# EasyEDA Pro project 立创天空星STM32F407主板.eprj, board PCB1 (continued)
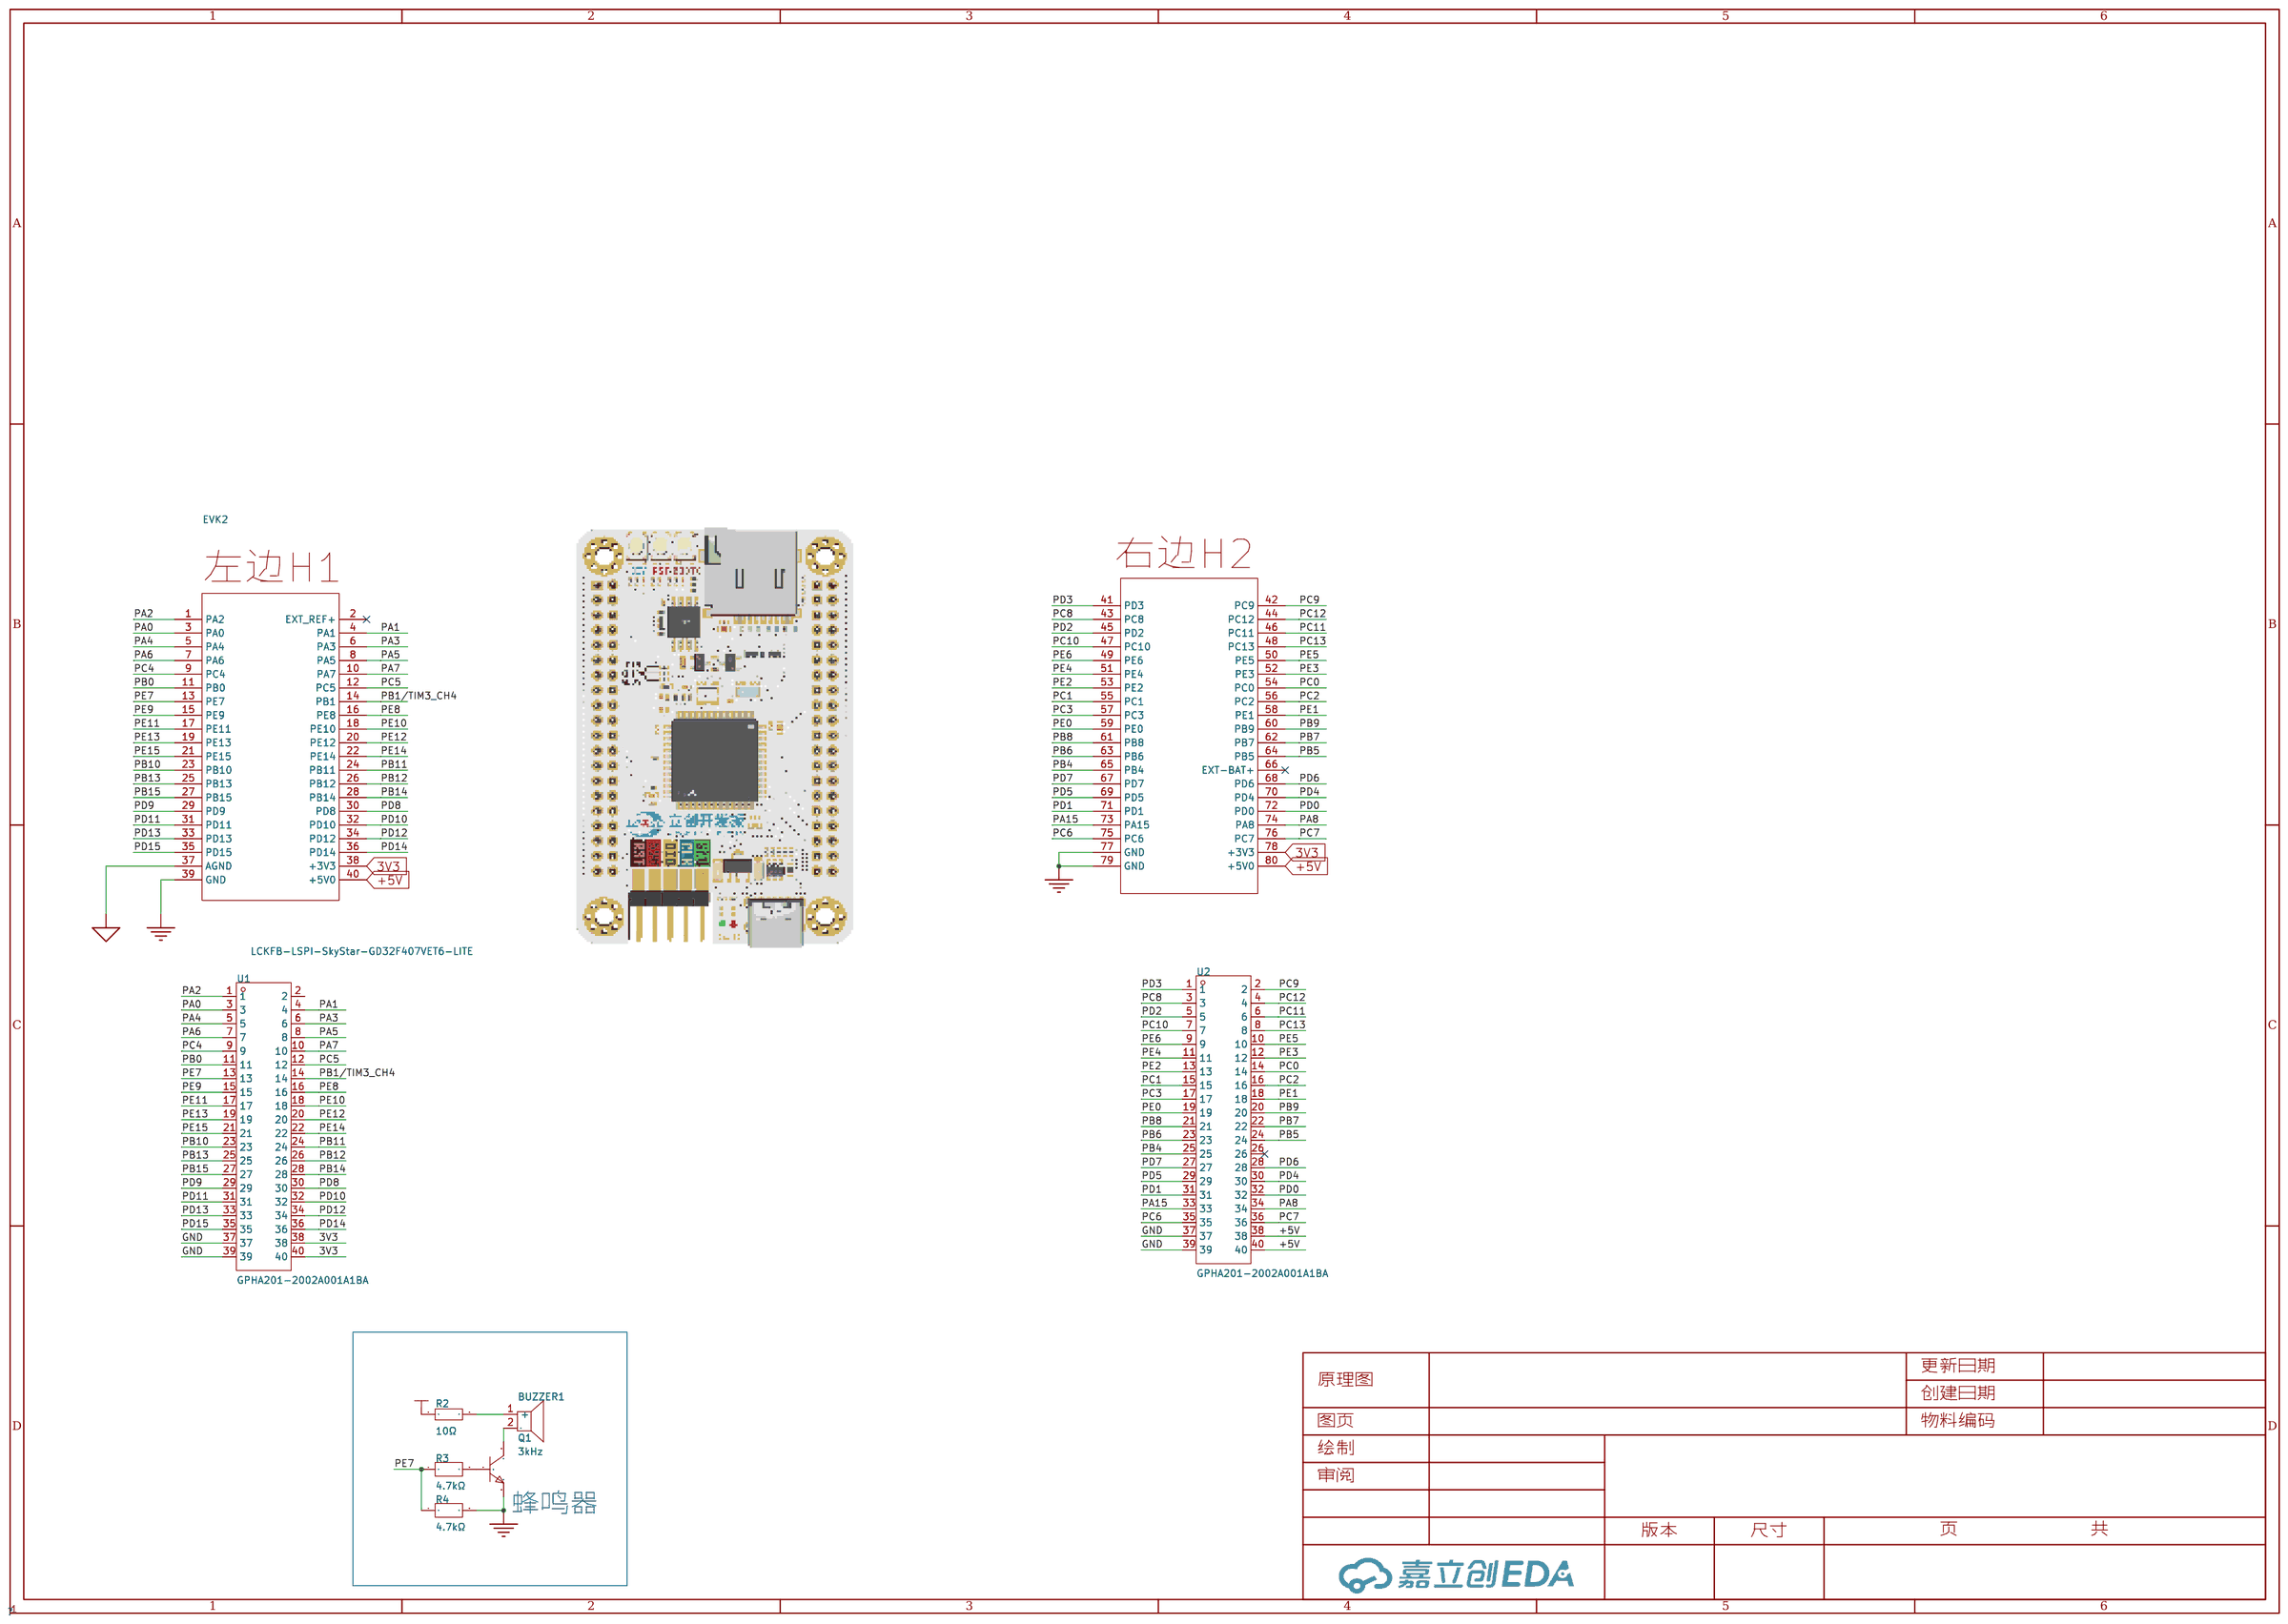
[diagram p0: 核心+音频输出]
## Footprints (pads in the part's own frame, mm; a bottom-side part is the same pattern mirrored in y, then rotated) (continued)
HDR-TH_40P-P2.54-V-M-R2-C20-S2.54
  rect 1.575x1.8 hole 1.1: 1(-24.13,-1.27)
  round 1.8 hole 1.1: 2(-24.13,1.27) 3(-21.59,-1.27) 4(-21.59,1.27) 5(-19.05,-1.27) 6(-19.05,1.27) 7(-16.51,-1.27) 8(-16.51,1.27) 9(-13.97,-1.27) 10(-13.97,1.27) 11(-11.43,-1.27) 12(-11.43,1.27) 13(-8.89,-1.27) 14(-8.89,1.27) 15(-6.35,-1.27) 16(-6.35,1.27) 17(-3.81,-1.27) 18(-3.81,1.27) 19(-1.27,-1.27) 20(-1.27,1.27) 21(1.27,-1.27) 22(1.27,1.27) 23(3.81,-1.27) 24(3.81,1.27) 25(6.35,-1.27) 26(6.35,1.27) 27(8.89,-1.27) 28(8.89,1.27) 29(11.43,-1.27) 30(11.43,1.27) 31(13.97,-1.27) 32(13.97,1.27) 33(16.51,-1.27) 34(16.51,1.27) 35(19.05,-1.27) 36(19.05,1.27) 37(21.59,-1.27) 38(21.59,1.27) 39(24.13,-1.27) 40(24.13,1.27)
IND-SMD_L5.2-W5.2_MCW-0530
  rect 1.9x2.5 smd: 1(-2.1,0) 2(2.1,0)
IND-SMD_L5.4-W5.2_FXL0530
  rect 1.9x2.5 smd: 1(-2.05,0) 2(2.05,0)
IND-SMD_L7.2-W6.6_GPSR07X0
  rect 2.35x3.5 smd: 1(-2.85,0) 2(2.85,0)
LED0603-RD
  rect 0.8x0.8 smd: 1(-0.799,0) 2(0.799,0)
LED0603-RD-YELLOW
  rect 0.8x0.8 smd: 1(-0.799,-0.004) 2(0.799,0.004)
LED0805-R-RD
  rect 1x1.399 smd: 1(1.05,0) 2(-1.05,0)
Pad_e2592
  round 10 hole 10: 1(0,0)
Pad_e2593
  oval 3.2x4.5 hole 3.2x4.5: 1(0,0)
Pad_e2594
  oval 3.2x5.2 hole 3.2x5.2: 1(0,0)
Pad_e2595
  oval 3.2x5.2 hole 3.2x5.2: 1(0,0)
Pad_e2596
  oval 3.2x5.2 hole 3.2x5.2: 1(0,0)
R0402
  rect 0.566x0.54 smd: 1(-0.433,0) 2(0.433,0)
R0603
  rect 0.806x0.864 smd: 1(-0.753,0) 2(0.753,0)
R0805
  rect 1.133x1.377 smd: 1(-1,0) 2(1,0)
RES-ADJ-SMD_3P-L3.8-W3.7_VGF39NCHXT
  rect 1.2x1.2 smd: 1(1.675,-1) 3(1.675,1)
  rect 1.6x1.5 smd: 2(-1.675,0.009)
SMA_L4.3-W2.6-LS5.0-FD
  rect 2.046x1.62 smd: 1(-2.304,-0.009) 2(2.304,0.009)
SOD-123_L2.7-W1.6-LS3.7-RD
  rect 0.91x1.22 smd: 1(-1.635,0) 2(1.635,0)
SOIC-16_L9.9-W3.9-P1.27-LS6.0-BL
  oval 0.602x1.971 smd: 1(-4.445,-2.736) 2(-3.175,-2.736) 3(-1.905,-2.736) 4(-0.635,-2.736) 5(0.635,-2.736) 6(1.905,-2.736) 7(3.175,-2.736) 8(4.445,-2.736) 9(4.445,2.736) 10(3.175,2.736) 11(1.905,2.736) 12(0.635,2.736) 13(-0.635,2.736) 14(-1.905,2.736) 15(-3.175,2.736) 16(-4.445,2.736)
SOT-23-3_L2.9-W1.3-P1.90-LS2.4-BR
  rect 1.25x0.7 smd: 1(1,-0.95) 2(1,0.95) 3(-1,0)
SOT-23-3_L3.0-W1.7-P0.95-LS2.9-BR
  rect 1.038x0.532 smd: 1(1.101,-0.95) 2(1.101,0.95) 3(-1.101,0)
SOT-23-5_L3.0-W1.7-P0.95-LS2.8-BL
  rect 0.49x1.157 smd: 1(-0.95,-1.153) 2(0,-1.153) 3(0.95,-1.153)
  rect 0.49x1.175 smd: 4(0.95,1.153) 5(-0.95,1.153)
SW-SMD_L6.0-W3.3-LS8.0
  rect 1.9x1.5 smd: 1(-4,0) 2(4,0)
SW-TH_SHOU-HAN_SS12D10G4
  oval 1.7x2.9 hole 1.1x2.3: 1(-4.8,0) 2(0,0) 3(4.8,0)
TO-252-2_L6.6-W6.1-P4.57-LS9.9-TL-CW
  rect 2.8x1.3 smd: 1(-3.292,2.273) 3(-3.292,-2.273)
  rect 6.5x6 smd: 2(3.292,0)
WIRELM-SMD_WT8266-S5-ESP-12F
  rect 2.5x1 smd: 1(-7.6,7.7) 2(-7.6,5.7) 3(-7.6,3.7) 4(-7.6,1.7) 5(-7.6,-0.3) 6(-7.6,-2.3) 7(-7.6,-4.3) 8(-7.6,-6.3) 9(7.6,-6.3) 10(7.6,-4.3) 11(7.6,-2.3) 12(7.6,-0.3) 13(7.6,1.7) 14(7.6,3.7) 15(7.6,5.7) 16(7.6,7.7)
  rect 1x1.8 smd: 17(-5,-7.7) 18(-3,-7.7) 19(-1,-7.7) 20(1,-7.7) 21(3,-7.7) 22(5,-7.7)
WIREPAD-4X6
  rrect 6x4 smd: 1(0,0)

## Nets
As in the schematic.

Pads without a net: CN2 3 4; EVK2 2 66; H5 2; H9 5 6; H10 5 6; H13 6; NOREF 1; NOREF#2 1; NOREF#3 1; NOREF#4 1; NOREF#5 1; P2 7 8; U1 2; U2 26; U9 4; U10 7; U11 7 10; U12 5 6; U13 2 4 5 6 7 11 13 14 17 18 19 20 21 22; X1 19 20

## Via types
v1: diameter 0.61, hole 0.305, Top Layer to Bottom Layer, 62 vias

## Routing (per net, layer and track width the routed paths; a pad name or vN(x,y) marks a point on that pad's centre or on a via; arc(x,y) is an arc through that point)
3V3: length 441.4
  Top Layer w0.254: 39.33,74.13 39.33,77.56 39.09,77.8 Q3.1 37.54,77.8 37.15,77.41 R50.2 ; 39.33,74.13 39.33,70.17 ; 39.33,74.13 39.25,74.05 Q4.1 37.73,74.05 37.22,73.55 R52.2 ; 39.33,70.17 39.25,70.25 Q5.1 38.27,70.32 37.68,70.32 37.22,69.86 R54.2 ; 39.33,70.17 39.33,62.26 45.72,55.88 ; X1.18 45.75,90.51
  Top Layer w0.762: 62.1,29.81 59.14,29.81 42.13,46.82 R2.1 42.13,52.29 63.08,73.24 63.08,84.72 ; 62.1,29.81 62.06,29.77 62.06,20.79 63.06,19.79 C23.2 66.53,19.77 R44.1 65.24,16.98 64.47,16.21 64.47,4.28 H10.2 61.17,0.98 44.53,0.98 43.78,1.73 43.78,2.7 ; 62.1,29.81 71.08,29.81 72.1,28.79 P1.2 ; U13.8 90.22,23.03 C22.2 ; H11.9 9.36,90.51 v1(46.44,90.51) C18.2 ; C22.2 90.26,31.24 ; C22.2 91.34,23.06 92.02,22.38 R43.1 R42.1 ; 90.26,31.24 90.26,35.39 98.26,43.4 98.26,85.69 94.31,89.63 R34.2 79.99,89.63 ; 90.26,31.24 90.21,31.2 R31.2 ; P2.1 41.13,9.72 43.78,7.07 43.78,2.7 ; U1.38 U1.40 76.54,87.4 76.54,89.45 76.43,89.56 ; H12.1 82.13,97.62 79.99,95.49 79.99,89.63 ; U9.5 46.44,89.56 ; R20.2 76.54,89.56 ; 76.54,89.56 76.43,89.56 ; 76.54,89.56 76.61,89.63 79.99,89.63 ; 76.43,89.56 64.92,89.56 63.08,87.72 63.08,84.72 ; 63.08,84.72 67.32,84.72 EVK2.38 ; 43.78,2.7 43.75,2.73 H9.2
  Bottom Layer w0.762: v1(46.44,90.51) 74,90.51 81.12,97.62 H12.1 ; EVK2.78 30.09,86.45 v1(30.09,90.48)
+5V: length 243.2
  Top Layer w0.508: 38.83,89.56 U9.1 42.19,89.56 42.51,89.24 42.51,88.1 42.07,87.66 U9.3
  Top Layer w0.762: v1(37.43,89.61) 37.48,89.56 C17.2 ; EVK2.80 29.97,89.11 24.65,89.11 U2.40 U2.38 18.4,84.83 12.27,78.69 R6.2 12.27,74.52 17.67,69.13 17.67,66.99 ; L1.1 v1(94.18,25.36) ; 17.67,66.99 17.53,67.13 11.66,67.13 11.65,67.12 11.65,65.24 12.28,64.61 R5.2 ; 17.67,66.99 H17.1 H16.1 ; U9.3 41.35,84.55 42.63,83.27 R55.2
  Bottom Layer w0.762: v1(94.18,25.36) 94.18,61.64 95.47,62.93 H13.1 95.47,95.02 94.64,95.85 80.85,95.85 74.62,89.61 67.35,89.61 ; EVK2.80 34.16,89.61 v1(37.43,89.61) 67.35,89.61 ; 67.35,89.61 67.37,89.59 EVK2.40
GND:
  vias: v1(0.72,44.67) v1(0.85,45.43) v1(1.1,77.99) v1(1.1,76.8) v1(1.53,45.43) v1(13.8,3.9) v1(13.8,2.71) v1(13.8,1.55) v1(45.17,88.41) v1(45.17,87.59) v1(45.68,87.08) v1(46.44,36.03) v1(46.44,35.13) v1(47.33,35.78) v1(47.33,34.67) v1(50.88,87.11) v1(51.27,87.97) v1(51.52,30.95) v1(51.52,30.05) v1(51.65,87.08) v1(52.54,87.08) v1(55.72,78.83) v1(56.61,79.59) v1(56.95,78.7) v1(57.37,43.4)
VCCBAT:
  vias: v1(7.12,35.14) v1(8.09,35.14) v1(8.22,37.43) v1(8.72,36.67) v1(8.72,35.76)
VCCSERVO: length 25.8
  Top Layer w0.762: R8.2 5.88,77.44
  Bottom Layer w0.762: 5.02,77.44 3.4,77.44 1.61,75.65 R7.2 ; 5.02,77.44 4.91,77.54 H4.2 H3.2 4.91,88.33 H15.2 ; 5.02,77.44 v1(5.88,77.44) D2.2
AD1: length 59.8
  Top Layer w0.254: EVK2.57 34.2,59.32 32.99,60.53 31.21,60.53 30.11,59.42 U2.17
  Bottom Layer w0.254: H11.7 15.46,89.5 25.61,89.5 26.89,88.23 26.89,60.86 U2.17
AD2: length 63
  Top Layer w0.254: EVK2.56 30.61,55.58 24.22,55.58 U2.16
  Bottom Layer w0.254: H11.6 17.49,90 25.81,90 27.3,88.51 27.3,59.18 26.25,58.13 24.15,58.13 U2.16
AD3: length 59
  Top Layer w0.254: EVK2.55 33.15,57.99 31.09,57.99 29.98,56.89 U2.15
  Bottom Layer w0.254: H11.5 19.52,90.51 26,90.51 27.74,88.77 27.74,58.85 25.77,56.89 U2.15
AD4: length 62
  Top Layer w0.254: EVK2.54 30.61,53.04 24.22,53.04 U2.14
  Bottom Layer w0.254: U2.14 24.15,55.59 26.38,55.59 28.18,57.39 28.18,88.96 26,91.15 21.42,91.15 H11.4
AD5: length 99.7
  Top Layer w0.254: v1(64.73,50.51) 67.91,50.51 69.2,49.21 EVK2.9 74.51,49.21 75.79,50.5 77.81,50.5 U1.9
  Bottom Layer w0.254: H11.3 23.33,91.78 26,91.78 28.6,89.17 28.6,55.25 30.81,53.05 53.47,53.05 56.01,50.51 v1(64.73,50.51)
AD6: length 92.6
  Top Layer w0.254: EVK2.12 68.63,50.5 75.2,50.5 U1.12
  Bottom Layer w0.254: EVK2.12 55.73,51.75 53.92,53.56 37.73,53.56 35.7,55.59 30.46,55.59 29.02,57.02 29.02,89.38 25.98,92.42 25.23,92.42 H11.2
AD7: length 92.1
  Top Layer w0.254: EVK2.11 74.63,51.75 75.92,53.04 77.81,53.04 U1.11
  Bottom Layer w0.254: H11.1 24.6,94.59 29.43,89.76 29.43,59.19 30.62,58 35.37,58 39.31,54.06 54.42,54.06 55.44,53.05 68.62,53.05 EVK2.11 ; 24.51,95.6 24.51,95.59
CLK: length 23.4
  Top Layer w0.254: v1(41.75,72.23) 41.82,72.3 R51.1 41.81,73.1 Q4.3 ; v1(49.75,78.45) U11.2 52.29,78.45 52.92,77.81 57.24,77.81 57.87,78.45 U10.2
  Bottom Layer w0.254: v1(49.75,78.45) 47.97,78.45 v1(41.75,72.23)
CLK_IN: length 18.3
  Top Layer w0.254: U2.23 29.68,67.05 30.78,68.15 33.15,68.15 EVK2.63 35.9,68.49 35.9,70.32 36.79,71.21 R52.1 36.97,72.68 37.5,72.15 Q4.2
DATA: length 26.5
  Top Layer w0.254: Q5.3 R53.1 41.87,69.25 v1(41.87,68.54) ; v1(54.19,86.83) 54.19,86.14 U10.9
  Bottom Layer w0.254: v1(54.19,86.83) 54.19,80.86 v1(41.87,68.54)
DATA_IN: length 20.1
  Top Layer w0.254: Q5.2 38.27,68.42 37.38,68.42 R54.1 36.79,66.64 35.78,65.62 33.13,65.62 EVK2.64 30.61,65.74 24.22,65.74 U2.24
ECD1_DIR: length 66.5
  Top Layer w0.254: EVK2.51 34.32,51.7 32.99,53.04 31.34,53.04 30.11,51.81 U2.11
  Bottom Layer w0.254: H9.4 38.32,4.03 35.52,4.03 28.28,11.27 28.28,48.97 U2.11
ECD1_PULSE: length 55.9
  Top Layer w0.254: U2.9 30.11,49.27 31.21,50.37 33.15,50.37 EVK2.49
  Bottom Layer w0.254: H9.3 39.62,43.9 EVK2.49
ECD2_DIR: length 52.1
  Top Layer w0.254: EVK2.4 68.76,40.21 75.07,40.21 U1.4
  Bottom Layer w0.254: H10.4 61.68,4.03 61.68,35.9 EVK2.4
ECD2_PULSE: length 54.2
  Top Layer w0.254: U1.3 77.81,42.88 75.92,42.88 74.63,41.59 EVK2.3
  Bottom Layer w0.254: H10.3 60.38,36.63 66.64,42.89 68.62,42.89 EVK2.3
ECHO: length 47.1
  Top Layer w0.254: U1.23 77.81,68.28 75.92,68.28 74.63,66.99 EVK2.23 ; H13.3 H12.3
  Bottom Layer w0.254: U1.23 81.9,67.05 90.39,75.53 H13.3
ESP/RX: length 65.4
  Top Layer w0.254: EVK2.1 74.51,39.05 75.79,40.34 78.84,40.34 79.09,40.08 79.09,39.15 U1.1
  Top Layer w0.762: U13.15 69.92,11.03 68.03,9.14 68.03,4.91 65.75,2.63 H14.2
  Bottom Layer w0.254: U1.1 79.08,39.07 79.08,30.19 77.94,29.05 67.53,29.05 65.62,27.14 65.62,13.93 v1(69.18,10.38)
ESP/TX: length 66.7
  Top Layer w0.254: EVK2.6 68.63,42.88 75.2,42.88 U1.6
  Top Layer w0.762: U13.16 69.99,9.03 v1(69.43,8.47) 69.18,8.22 69.18,4.41 68.29,3.52 H14.1
  Bottom Layer w0.254: v1(69.43,8.47) 64.86,13.04 64.86,27.27 67.15,29.55 71.21,29.55 72.99,31.33 72.99,40.6 70.7,42.89 69.3,42.89 68.06,44.13 EVK2.6
ICM_CS: length 48.2
  Top Layer w0.254: U1.5 77.81,45.42 75.92,45.42 74.63,44.13 EVK2.5
  Bottom Layer w0.254: EVK2.5 68.62,45.43 66.51,45.43 59.53,38.44 59.53,22.31 P2.6
ICM_MISO: length 52.7
  Top Layer w0.254: U1.7 77.81,47.96 75.92,47.96 74.63,46.67 EVK2.7
  Bottom Layer w0.254: P2.5 52.93,18.25 54.44,18.25 58.76,22.57 58.76,40.22 66.51,47.97 68.62,47.97 EVK2.7
ICM_MOSI: length 54.4
  Top Layer w0.254: U1.10 75.2,47.96 68.63,47.96 EVK2.10
  Bottom Layer w0.254: EVK2.10 66.87,49.21 44.41,26.76 44.41,20.95 P2.4
ICM_SCK: length 110.8
  Top Layer w0.254: U1.8 75.2,45.42 68.63,45.42 EVK2.8
  Bottom Layer w0.254: EVK2.8 68.19,46.67 69.43,45.43 70.57,45.43 71.34,46.19 71.34,49.75 70.61,50.47 66.97,50.47 43.78,27.28 43.78,19.04 P2.3 ; U1.8 77.75,47.97 83.66,47.97 93.05,38.57 93.05,19.27 H5.8
IIC_SCK: length 46.1
  Top Layer w0.254: U12.2 49.37,35.64 37.94,47.08 37.94,60.82 EVK2.61 33.82,64.4 32.61,65.61 31.21,65.61 30.11,64.5 U2.21
IIC_SDA: length 50.9
  Top Layer w0.254: U2.20 24.22,60.66 30.61,60.66 EVK2.60 32.3,61.86 33.62,60.54 35.14,60.54 36.92,58.76 36.92,43.27 47.08,33.11 50.37,33.11 50.62,33.36 U12.3
IN1: length 14.3
  Top Layer w0.254: U10.6 58.38,83.53 58.13,83.78 58.13,88.73 54.25,92.61 X1.1
IN2: length 15.7
  Top Layer w0.254: 53.75,94.89 53.75,92.61 57.75,88.61 57.75,83 58.48,82.26 U10.5
IN3: length 17.4
  Top Layer w0.254: U10.4 58.13,80.99 57.37,81.75 57.37,88.35 53.25,92.47 X1.3
IN4: length 19.1
  Top Layer w0.254: 52.75,94.89 52.75,92.08 56.98,87.85 56.98,80.48 57.75,79.72 U10.3
IN5: length 18.9
  Top Layer w0.254: X1.5 52.25,91.95 56.63,87.57 56.63,80.76 55.59,79.72 U10.14
IN6: length 17.3
  Top Layer w0.254: U10.13 55.21,80.99 56.22,82 56.22,87.47 51.75,91.94 51.75,94.89
IN7: length 15.9
  Top Layer w0.254: U10.12 55.21,82.26 55.84,82.89 55.84,87.08 51.25,91.68 X1.7
IN8: length 14.5
  Top Layer w0.254: X1.8 50.75,91.41 55.49,86.68 55.49,83.88 55.13,83.53 U10.11
IN9: length 12.6
  Top Layer w0.254: X1.9 50.25,92.66 50.01,92.42 50.01,83.77 50.25,83.53 U11.6
IN10: length 14.1
  Top Layer w0.254: X1.10 49.75,92.92 49.65,92.82 49.65,82.73 50.13,82.26 U11.5
IN11: length 15.7
  Top Layer w0.254: X1.11 49.25,81.48 49.75,80.99 U11.4
IN12: length 17.3
  Top Layer w0.254: U11.3 49.49,79.72 48.86,80.35 48.86,92.16 48.75,92.27 X1.12
IN13: length 17.3
  Top Layer w0.254: X1.13 48.25,92.14 48.48,91.91 48.48,80.61 47.59,79.72 45.87,79.72
IN14: length 15.8
  Top Layer w0.254: X1.14 47.75,91.87 48.04,91.58 48.04,81.7 47.33,80.99 45.87,80.99
IN15: length 14.2
  Top Layer w0.254: 45.87,82.26 46.95,82.26 47.69,83 47.69,91.3 47.25,91.74 X1.15
IN16: length 12.9
  Top Layer w0.254: X1.16 46.75,91.6 47.33,91.02 47.33,83.78 47.08,83.53 45.87,83.53
IPS_BL: length 2.3
  Top Layer w0.762: R31.1 P1.8
IPS_CS: length 55.7
  Top Layer w0.254: U1.26 75.2,68.28 73.79,68.28 73.78,68.29 ; EVK2.26 68.63,68.28 73.77,68.28 ; P1.7 84.8,28.54 v1(78.45,34.89)
  Bottom Layer w0.254: v1(78.45,34.89) 75.15,38.19 75.15,42.51 73.77,43.88 v1(73.77,68.29)
IPS_DC: length 67.7
  Top Layer w0.254: U1.34 75.2,78.44 68.63,78.44 EVK2.34 ; v1(78.45,33.74) 82.26,29.93 P1.6
  Bottom Layer w0.254: v1(78.45,33.74) 74.64,37.55 74.64,42.13 73.11,43.65 73.11,76.35 U1.34
IPS_MOSI: length 55.1
  Top Layer w0.254: R47.1 v1(77.94,31.2) ; EVK2.27 74.63,72.07 75.92,73.36 77.81,73.36 U1.27
  Bottom Layer w0.254: EVK2.27 72.22,69.76 72.22,42.89 73.75,41.36 73.75,35.39 v1(77.94,31.2)
IPS_RST: length 63.8
  Top Layer w0.254: EVK2.28 68.63,70.82 75.2,70.82 U1.28 ; v1(77.69,32.86) 79.72,30.82 P1.5
  Bottom Layer w0.254: EVK2.28 68.67,73.37 70.7,73.37 72.61,71.46 72.61,43.27 74.26,41.62 74.26,36.28 v1(77.69,32.86)
IPS_SCK: length 51.7
  Top Layer w0.254: U1.25 77.81,70.82 75.92,70.82 74.63,69.53 EVK2.25 ; R46.1 v1(75.53,31.2)
  Bottom Layer w0.254: v1(75.53,31.2) 73.37,33.35 73.37,40.98 71.84,42.51 71.84,67.6 EVK2.25
PA8: length 22.4
  Top Layer w0.254: EVK2.74 30.61,78.44 24.22,78.44 U2.34 ; v1(12.92,82.26) R26.2
  Bottom Layer w0.254: v1(12.92,82.26) 15.43,79.75 U2.34
PA15: length 9.9
  Top Layer w0.254: EVK2.73 33.15,80.85 31.09,80.85 29.98,79.75 U2.33
PB1/TIM3_CH4: length 11.8
  Top Layer w0.254: U1.14 75.2,53.04 68.63,53.04 EVK2.14 67.14,54.06 65.88,54.06
PB4: length 19.7
  Top Layer w0.254: U2.25 30.11,69.59 31.21,70.69 33.15,70.69 EVK2.65 35.78,70.91 35.78,74 36.77,75 R50.1 37.05,76.54 37.69,75.9 Q3.2
PB7: length 9.9
  Top Layer w0.254: U2.22 24.22,63.2 30.61,63.2 EVK2.62
PB11: length 47.1
  Top Layer w0.254: U1.24 75.2,65.74 68.63,65.74 EVK2.24 ; H12.2 H13.4
  Bottom Layer w0.254: H13.4 87.85,75.65 80.48,68.29 77.75,68.29 U1.24
PC6: length 26.4
  Top Layer w0.254: EVK2.75 33.02,83.52 26.68,83.52 U2.35 ; v1(12.92,88.35) R48.2
  Bottom Layer w0.254: U2.35 24.21,83.53 17.74,83.53 v1(12.92,88.35)
PC7: length 22.6
  Top Layer w0.254: R25.2 v1(12.92,85.31) ; EVK2.76 30.61,80.98 24.22,80.98 U2.36
  Bottom Layer w0.254: v1(12.92,85.31) 15.94,82.28 U2.36
PC8: length 55.7
  Top Layer w0.254: U2.3 29.98,41.64 31.09,42.75 33.15,42.75 EVK2.43 44.16,31.74 44.16,20.79 47.46,17.49 47.46,14.95 54.95,7.46 R29.1
PC9: length 49.3
  Top Layer w0.254: R21.1 51.02,8.39 44.92,14.5 44.92,17.49 43.65,18.76 43.65,27.17 EVK2.42 30.49,37.68 24.33,37.68 U2.2
PC10: length 26.8
  Top Layer w0.254: U2.7 30.11,46.73 31.34,47.96 33.12,47.96 34.35,46.72 EVK2.47
  Bottom Layer w0.254: U2.7 27.65,44.53 27.65,34.19 H16.4
PC11: length 76.1
  Top Layer w0.254: R30.2 v1(45.05,5.42) ; EVK2.46 30.61,42.88 24.22,42.88 U2.6
  Bottom Layer w0.254: v1(45.05,5.42) 43.52,3.9 39.08,3.9 38.32,4.66 38.32,6.44 29.81,14.95 29.81,42.08 EVK2.46 ; H16.3 21.42,33.15 21.42,42.7 U2.6
PC12: length 17.4
  Top Layer w0.254: EVK2.44 30.62,40.35 24.21,40.35 U2.4
  Bottom Layer w0.254: H17.4 24.22,36.21 24.22,40.34 U2.4
PC13: length 9.9
  Top Layer w0.254: U2.8 24.22,45.42 30.61,45.42 EVK2.48
PD0: length 9.9
  Top Layer w0.254: U2.32 24.22,75.9 30.61,75.9 EVK2.72
PD1: length 9.9
  Top Layer w0.254: U2.31 30.11,77.2 31.21,78.31 33.15,78.31 EVK2.71
PD2: length 25.3
  Top Layer w0.254: U2.5 29.98,44.19 31.09,45.29 33.15,45.29 EVK2.45
  Bottom Layer w0.254: H17.3 24.27,33.62 25.97,33.62 26.94,34.59 26.94,42.7 U2.5
PD3: length 48.4
  Top Layer w0.254: v1(48.98,8.6) 48.98,7.72 48.97,7.71 ; U2.1 30.11,39.11 31.21,40.21 33.75,40.21 34.35,39.61 EVK2.41 35.72,39 v1(42.38,32.35)
  Bottom Layer w0.254: v1(48.98,8.6) 42.38,15.2 v1(42.38,32.35)
PD4: length 9.9
  Top Layer w0.254: U2.30 24.22,73.36 30.61,73.36 EVK2.70
PD5: length 9.9
  Top Layer w0.254: U2.29 30.11,74.67 31.21,75.77 33.15,75.77 EVK2.69
PD6: length 9.9
  Top Layer w0.254: EVK2.68 30.61,70.82 24.22,70.82 U2.28
PD7: length 9.9
  Top Layer w0.254: U2.27 29.98,72.12 31.09,73.23 33.15,73.23 EVK2.67
PD8: length 96.3
  Top Layer w0.254: U1.30 75.21,73.37 68.62,73.37 EVK2.30
  Bottom Layer w0.254: U1.30 74.51,72.67 74.51,44.03 75.65,42.89 84.92,42.89 90.77,37.05 90.77,11.27 94.2,7.84 96.99,7.84 97.62,8.47 H5.1
PD9: length 93.8
  Top Layer w0.254: EVK2.29 74.61,74.61 75.91,75.91 77.8,75.91 U1.29
  Bottom Layer w0.254: H5.3 96.35,10.88 93.18,10.88 91.53,12.53 91.53,37.55 83.66,45.43 75.78,45.43 75.02,46.19 75.02,72.48 75.91,73.37 77.75,73.37 U1.29
PD10: length 22.5
  Top Layer w0.254: EVK2.32 68.63,75.9 75.2,75.9 U1.32 77.28,77.2 78.58,75.9 88.04,75.9 SW3.1
PD11: length 20.7
  Top Layer w0.254: EVK2.31 74.51,77.15 75.79,78.44 77.81,78.44 U1.31 82.17,80.33 SW4.1
PD13: length 10.2
  Top Layer w0.254: U1.33 77.81,80.98 75.92,80.98 74.63,79.69 EVK2.33
PD14: length 10.2
  Top Layer w0.254: U1.36 75.2,80.98 68.63,80.98 EVK2.36
PD15: length 10.2
  Top Layer w0.254: U1.35 77.81,83.52 71.2,83.52 EVK2.35
PE0: length 9.9
  Top Layer w0.254: EVK2.59 34.35,61.96 33.24,63.07 31.21,63.07 30.11,61.97 U2.19
PE1: length 9.9
  Top Layer w0.254: U2.18 24.22,58.12 30.61,58.12 EVK2.58
PE2: length 9.9
  Top Layer w0.254: EVK2.53 33.15,55.45 31.09,55.45 29.98,54.34 U2.13
PE3: length 9.9
  Top Layer w0.254: EVK2.52 30.61,50.5 24.22,50.5 U2.12
PE5: length 9.9
  Top Layer w0.254: U2.10 24.22,47.96 30.61,47.96 EVK2.50
PE7: length 23.1
  Top Layer w0.254: R4.1 63.22,52.29 66.39,55.47 68.23,55.47 68.48,55.22 68.98,55.22 EVK2.13 74.63,54.29 75.92,55.58 77.81,55.58 U1.13
  Top Layer w0.762: R3.1 R4.1
PE8: length 10.2
  Top Layer w0.254: U1.16 75.2,55.58 68.63,55.58 EVK2.16
PE9: length 61.5
  Top Layer w0.254: EVK2.15 74.63,56.83 75.92,58.12 77.81,58.12 U1.15 83.66,52.28 v1(83.66,46.7)
  Bottom Layer w0.254: 83.75,46.73 92.29,38.19 92.29,14.95 H5.4
PE10: length 30.3
  Top Layer w0.254: R23.2 92.93,53.55 88.35,58.13 78.45,58.13 77.15,59.42 U1.18 75.2,58.12 68.63,58.12 EVK2.18
PE11: length 30.2
  Top Layer w0.254: EVK2.17 74.51,59.37 75.79,60.66 77.81,60.66 U1.17
  Top Layer w0.762: U1.17 89.04,59.42 R24.2
PE12: length 26
  Top Layer w0.254: SW1.1 88.24,66.26 82.64,60.67 78.45,60.67 77.15,61.97 U1.20 75.2,60.66 68.63,60.66 EVK2.20
PE13: length 10.2
  Top Layer w0.254: EVK2.19 74.51,61.91 75.79,63.2 77.81,63.2 U1.19
PE14: length 10.2
  Top Layer w0.254: U1.22 75.2,63.2 68.63,63.2 EVK2.22
PE15: length 22.4
  Top Layer w0.254: SW2.1 86.39,71.85 U1.21 77.81,65.74 75.79,65.74 74.51,64.45 EVK2.21
SH: length 25.1
  Top Layer w0.254: Q3.3 R49.1 v1(41.8,76.03) ; U10.1 57.62,77.18 56.98,76.54 53.05,76.54 52.41,77.18 U11.1 v1(49.62,77.18)
  Bottom Layer w0.254: v1(41.8,76.03) 45.01,79.25 50.19,79.25 50.56,78.88 50.56,78.12 v1(49.62,77.18)
VD: length 25.9
  Top Layer w0.508: 42.69,69.3 42.67,69.32 R49.2 ; R55.1 42.67,79.57 R49.2 ; R49.2 43.74,76.85 C20.1 44.07,77.18 48.1,77.18 49.37,75.91 v1(54.32,75.91) ; U10.16 v1(55.59,77.18)
  Bottom Layer w0.508: v1(55.59,77.18) v1(54.32,75.91)
$1N8508: length 3
  Top Layer w0.762: Q1.1 58.21,49.66 58.64,49.24 60.28,49.24 R3.2
$1N8510: length 3.5
  Top Layer w0.762: 55.98,51.37 BUZZER1.2
$1N8512: length 3.9
  Top Layer w0.762: BUZZER1.1 47.47,51.4 R2.2
$2N1085: length 2.8
  Top Layer w0.762: LED1.2 92.97,50.23 R23.1
$2N1087: length 2.8
  Top Layer w0.762: R24.1 96.15,47.58 LED3.2
$2N16423: length 2.4
  Top Layer w0.254: H8.2 47.46,7.7 R22.1
$2N16424: length 2.4
  Top Layer w0.254: H8.6 52.54,7.7 52.53,7.71
$2N16425: length 2.4
  Top Layer w0.254: H8.5 54.92,2.73 R29.2
$2N16426: length 2.4
  Top Layer w0.254: R30.1 47.42,2.76 H8.1
$2N16659: length 2.8
  Top Layer w0.762: R34.1 H13.5
$2N17066: length 2.5
  Top Layer w0.762: 10,85.31 H3.3
$2N17071: length 2.5
  Top Layer w0.762: 10,82.26 H4.3
$2N17434: length 9.1
  Top Layer w0.762: C19.1 98.28,25.9 L1.2 98.28,17.89 H5.7
$2N17714: length 2.3
  Top Layer w0.762: P1.3 R46.2
$2N17715: length 2.3
  Top Layer w0.762: P1.4 R47.2
$2N18202: length 2.5
  Top Layer w0.762: H15.3 7.5,88.35 10,88.35
$2N22566: length 11.7
  Top Layer w0.254: v1(44.41,86.07) 45.87,86.07 ; U10.10 v1(52.92,84.8)
  Bottom Layer w0.254: v1(44.41,86.07) 45.68,84.8 v1(52.92,84.8)
$3N925: length 3.1
  Top Layer w0.762: R42.2 86.98,8.98 U13.1
$3N927: length 3.1
  Top Layer w0.762: R43.2 90,13.03 U13.3
$3N1259: length 3.1
  Top Layer w0.762: R45.2 71.7,21.06 U13.10
$3N2980: length 7.5
  Top Layer w0.762: SW6.1 67.72,14.38 68.54,15.2 68.54,16.96 R44.2 71.69,16.98 U13.12
$4N307: length 15.8
  Top Layer w0.762: v1(2.88,24.09) 2.89,24.1 Q2.1
  Bottom Layer w0.762: v1(2.88,24.09) 12.28,14.69 SW7.2
$4N309: length 20.4
  Top Layer w0.762: R19.2 SW7.3 16.73,12.81 16.73,22.49 15.12,24.09 D5.2
$4N1993: length 2.3
  Top Layer w0.762: R15.1 9.63,49.76 U5.4
$4N1994: length 2.6
  Top Layer w0.762: U5.6 6.19,56.35 6.69,56.86 R9.2
$4N1996: length 4
  Top Layer w0.762: C5.1 7.82,71.73 D1.1
$4N1999: length 2.9
  Top Layer w0.762: R10.2 R5.1
$4N2000: length 6.2
  Top Layer w0.762: U5.5 8.46,55.58 9.11,56.22 9.11,57.11 9.6,57.61 R16.2 12.26,57.61 R10.1
$4N2002: length 1.8
  Top Layer w0.762: LED6.2 10.76,76.67 R6.1
$4N2003: length 2
  Top Layer w0.762: R9.1 8.65,59.52 C9.1
$4N2008: length 1.9
  Top Layer w0.762: R20.1 LED7.2
$4N2012: length 4.2
  Bottom Layer w0.762: R17.1 1.36,50.89 2.49,49.76 U6.4
$4N2013: length 2
  Bottom Layer w0.762: R11.2 4.91,57.61 U6.6
$4N2018: length 2.1
  Top Layer w0.762: R8.1 3.05,78.95 LED2.2
$4N2019: length 1.7
  Bottom Layer w0.762: C10.1 3.45,57.67 R11.1
$4N2021: length 1.9
  Bottom Layer w0.762: R12.1 1.62,66.64 R7.1
$4N2022: length 1.7
  Bottom Layer w0.762: R18.2 3.62,66.48 R12.3
$4N2023: length 6.8
  Bottom Layer w0.762: U6.5 3.02,55.58 2.46,56.13 2.46,61.27 2.63,61.44

## Copper pours and planes (outline as drawn; the poured copper is in the pictures)
3V3 on Top Layer: 51.46,37.49 55.45,37.49 55.45,33.36 51.46,33.36
GND on Top Layer: -4.23,114.39 118.96,114.39 118.96,-19.72 -4.23,-19.72
GND on Bottom Layer: -6.13,114.64 115.66,114.64 115.66,-18.96 -6.13,-18.96
VCC on Top Layer: 6.31,21.93 6.69,22.31 6.69,25.24 7.2,25.74 11.14,25.74 11.65,25.24 11.65,22.44 12.15,21.93 15.38,21.93 15.84,21.48 15.84,17.38 15.29,16.84 1.12,16.84 0.47,17.49 0.47,21.43 0.98,21.93
VCCBAT on Top Layer: 6.06,37.94 8.6,37.94 9.74,36.79 9.74,27.27 9.23,26.76 2.88,26.76 2.25,27.39 2.25,33.74 2.88,34.38 5.17,34.38 5.68,34.89 5.68,37.55
VCCBAT on Top Layer: 9.36,37.17 21.68,24.85 36.54,24.85 36.92,24.47 36.92,23.58 36.54,23.2 29.55,23.2 28.25,21.9 28.25,1.71 27.14,0.6 21.81,0.6 20.54,1.87 20.54,19.65 13.42,26.76 7.74,26.76 6.18,28.32 6.18,34
$4N1990 on Top Layer: 2.19,52.89 4.15,50.93 4.15,49.11 3.9,48.86 0.85,48.86 0.34,49.37 0.34,52.54 0.7,52.89
$4N1991 on Top Layer: 1.61,59.78 4.15,59.78 4.66,59.27 4.66,57.37 4.28,56.98 4.28,55.03 3.97,54.72 2.36,54.72 2.07,54.43 2.07,53.31 1.93,53.17 0.58,53.17 0.43,53.33 0.43,58.59
$4N1992 on Top Layer: 1.23,35.39 0.98,35.65 0.98,40.09 0.34,40.73 0.34,43.29 3.19,46.14 3.19,47.77 4.41,48.98 4.41,50.38 4.64,50.62 6.46,50.62 6.69,50.38 6.69,48.6 7.2,48.09 7.2,46.44 4.79,44.03 4.79,36.03 4.15,35.39
$4N1996 on Top Layer: 12.16,73.36 13.04,72.48 13.04,70.83 12.53,70.32 8.87,70.32 7.99,69.43 7.99,66.28 5.3,63.59 5.3,61.94 4.41,61.05 1.36,61.05 0.6,61.81 0.6,63.46 1.1,63.97 2.58,63.97 3.01,64.4 3.01,66.89 5.04,68.92 5.04,72.61 5.8,73.36
$4N2009 on Bottom Layer: 8.01,51.32 7.07,50.38 7.07,49.11 7.33,48.86 10.38,48.86 10.76,49.24 10.76,50.94 10.37,51.32
$4N2010 on Bottom Layer: 9.07,51.7 8.75,52.02 8.75,53.66 7.94,54.46 7.11,54.46 6.88,54.7 6.88,56.17 7.22,56.51 15.78,56.51 16.31,55.98 16.31,52.4 15.61,51.7
$4N2011 on Bottom Layer: 4.68,50.62 4.43,50.37 4.43,49 3.26,47.84 3.26,46.19 0.35,43.28 0.35,36.02 1.23,35.14 3.91,35.14 4.66,35.9 4.66,44.41 5.8,45.56 6.81,45.56 7.33,46.07 7.33,48.3 6.69,48.94 6.69,50.25 6.33,50.62
$4N2015 on Bottom Layer: 10.63,79.08 9.61,78.07 9.61,68.42 10.76,67.27 10.76,58.56 11.37,57.96 15.79,57.96 16.34,58.51 16.34,78.19 15.46,79.08

Small or netless copper shapes (teardrops, artwork), in the pictures only: 410 on Top Layer, 110 on Bottom Layer

## Text on the board
Top Silkscreen Layer: RX | TX | NC | ESP8266 | PE10 | PE11 | B13 | B15 | B14 | D12 | B12 | 3.3 | b11 | b10 | g | 5v | G | a8 | c7 | c6 | 5V | 1-7 | D2 | C11 | C12 | C10 | P | A5 | A7 | A6 | A4 | e7 | tof | GND | vcc | 舵机电源 | 舵机 | 串口4 | 串口3 | 灰度循迹 | 电机供电 | 庐山派供电 | 陀螺仪 | 电机 | 庐山派_IIC0 | 16路红外 | 超声波 | 屏幕 | 无线串口 | 关 | 开 | WIFI模块 | C02 | C00 | E01 | C13 | D06 | B09 | E03 | E05 | D00 | B05 | B07 | C09 | C07 | C08 | D04 | +5V | C01 | E06 | A15 | B06 | E00 | E02 | C06 | D05 | D07 | B08 | E04 | D02 | D03 | B04 | C03 | D01 | 3V3 | E14 | D10 | D08 | D14 | B11 | E12 | A03 | E10 | E08 | B01 | C05 | A07 | A05 | A01 | E15 | A02 | D15 | D13 | B10 | D09 | D11 | E13 | E11 | E09 | E07 | B00 | C04 | A06 | A04 | A00 | PD11 | PD10 | PE15 | PE12
